# EasyEDA Pro project ProPrj_Avaota A1 八核 AIoT 开发板_2024-05-20.epro, board PCB1 (continued)
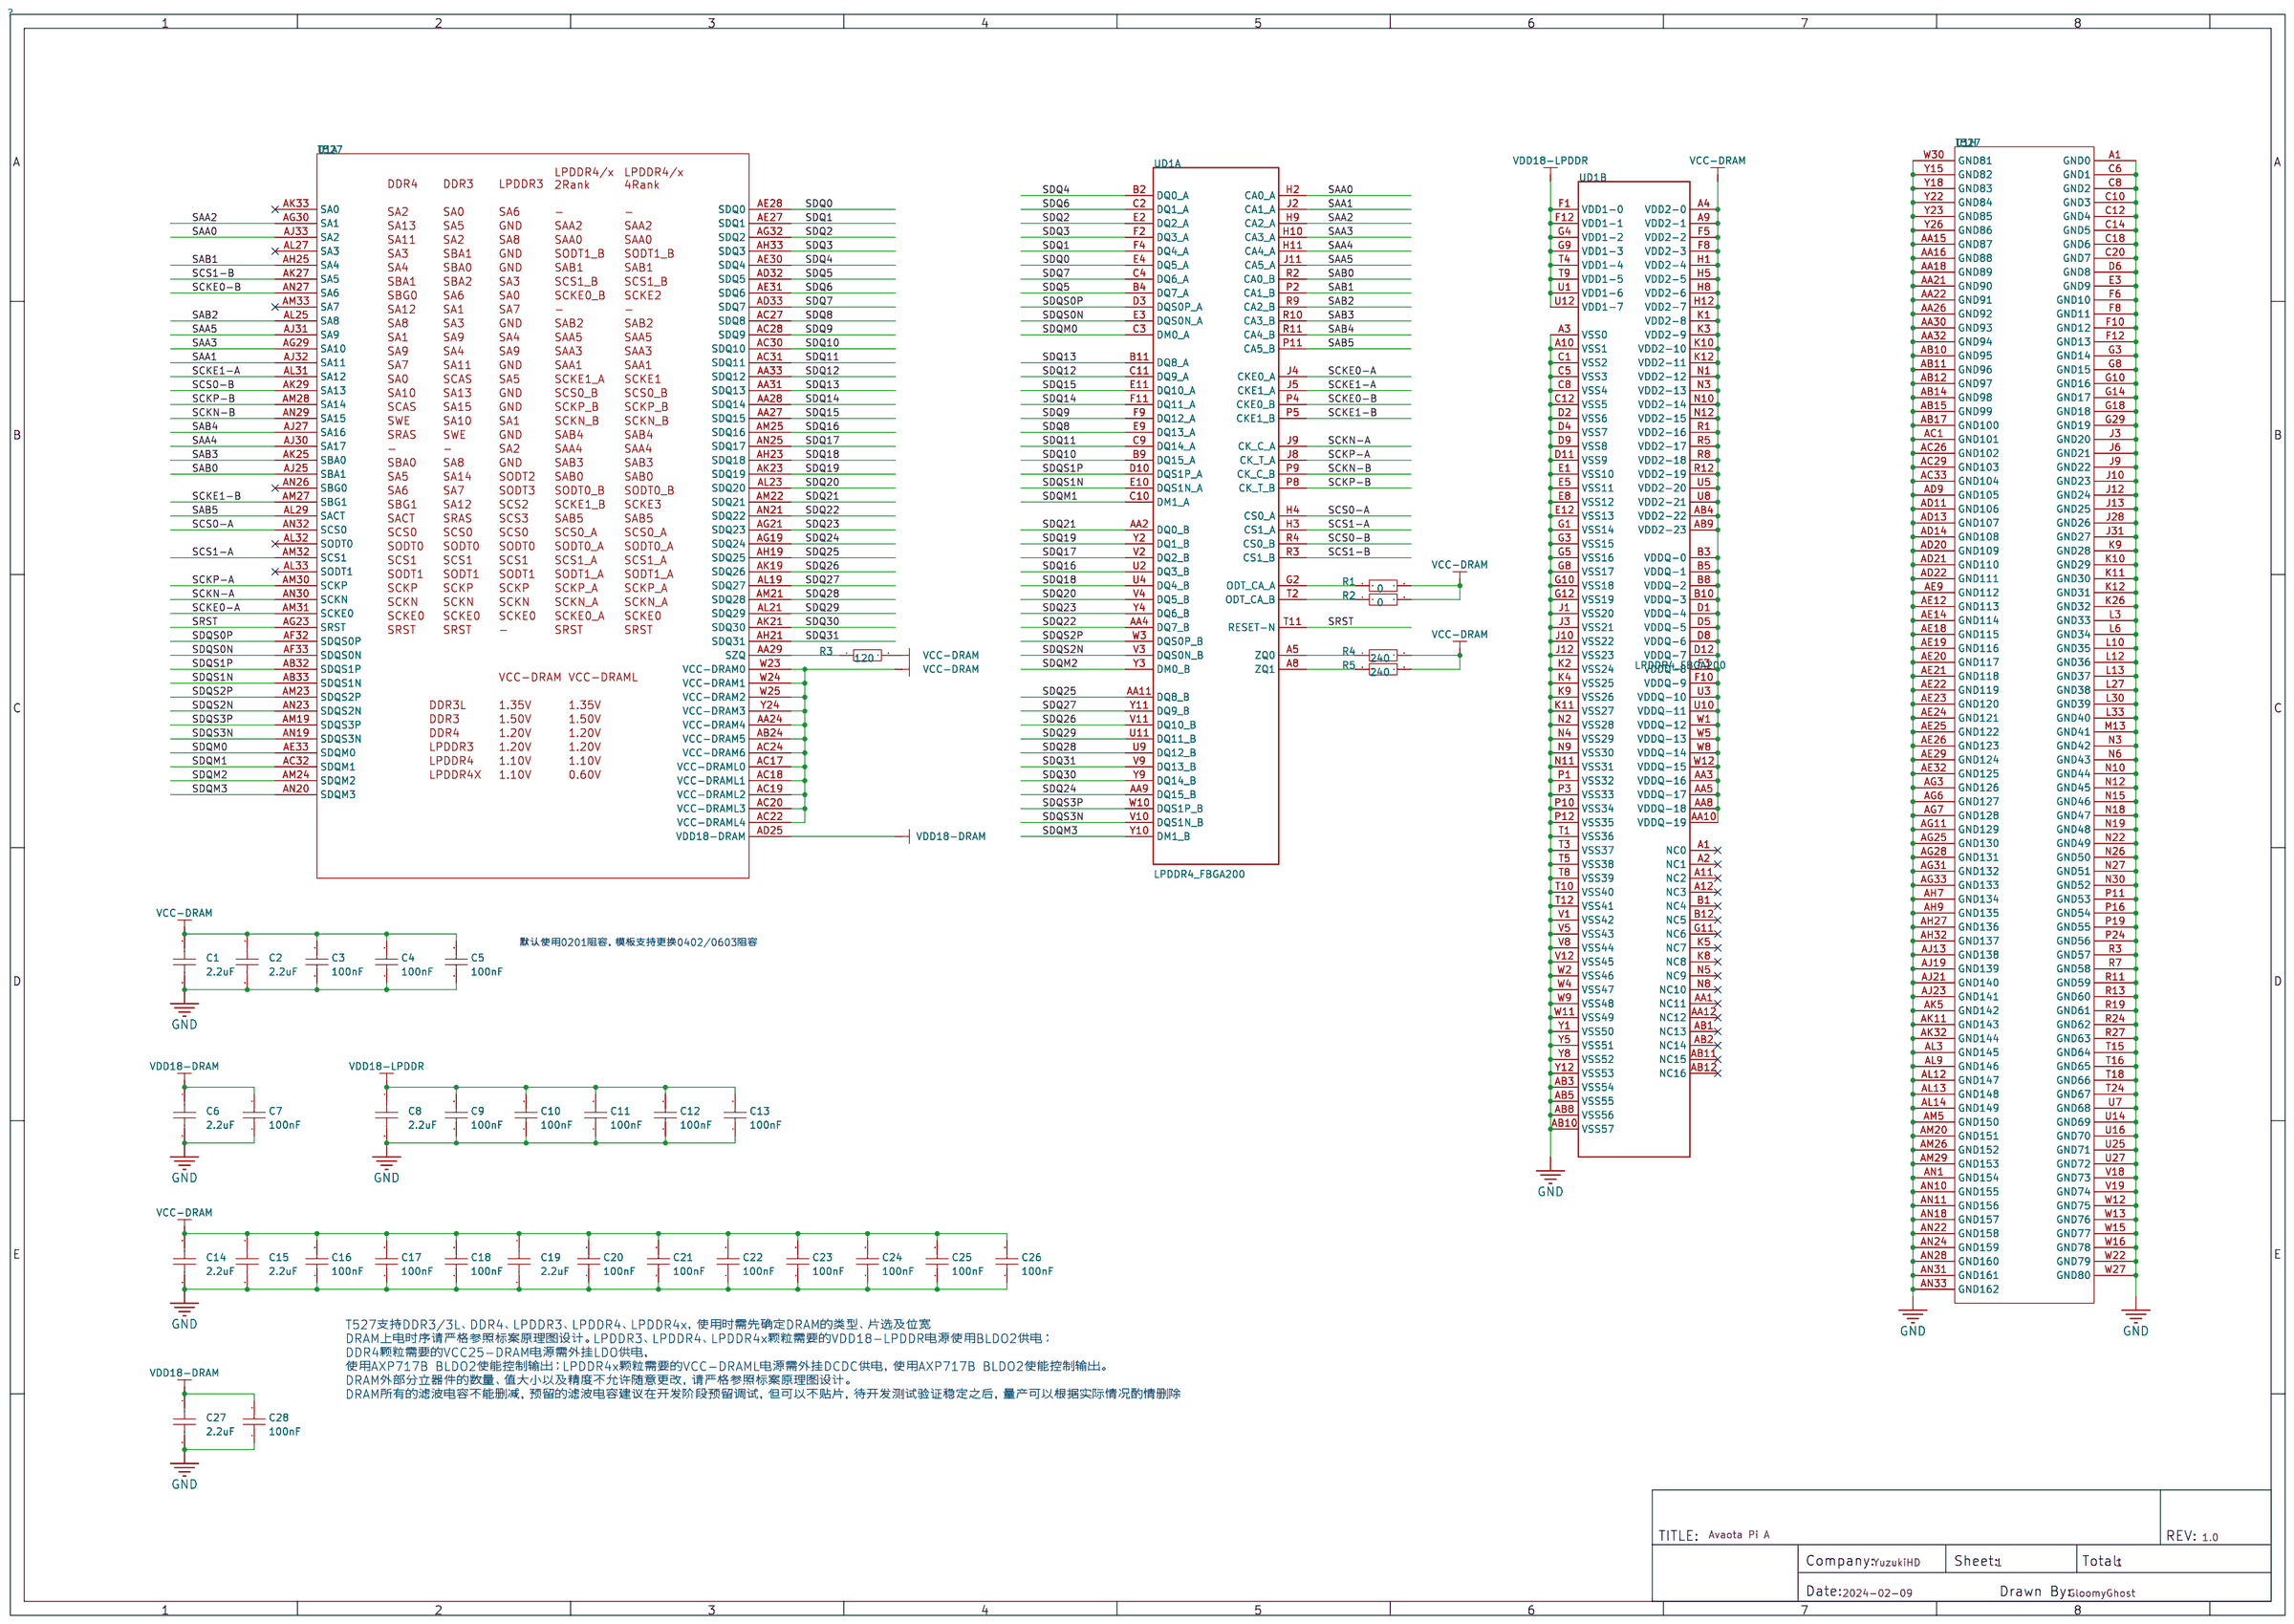
[diagram p0: schematic sheet]
## Routing (per net, layer and track width the routed paths; a pad name or vN(x,y) marks a point on that pad's centre or on a via; arc(x,y) is an arc through that point) (continued)
  Bottom Layer w0.254: 51.81,43.63 51.81,43.51 v2(52.09,43.23) ; 51.81,43.63 51.66,43.79 51.61,43.79 ; 51.81,43.63 51.81,43.84 52.55,43.84 52.58,43.87 ; 43.2,43.2 42.73,43.2 v2(42.58,43.05) ; 58.32,52.65 v1(57.45,52.65) 57.54,52.57 C102.1 ; 58.32,52.65 57.94,53.04 57.94,53.48 C103.1 ; 58.32,52.65 C113.1 ; C67.2 C57.2 C58.2 ; C21.2 C22.2 61.95,44.56 60.99,44.56 ; 36.1,42.06 35.58,42.06 35.33,41.81 34.64,41.81 v2(34.52,41.94) ; v1(72.31,44.22) 73.18,43.36 73.18,40.64 74.7,39.12 76.33,39.12 78.89,36.55 78.89,31.8 76.1,29.01 48.74,29.01 45.09,25.35 36.63,25.35 v1(30.18,18.9) ; 34.75,54.27 35.11,54.27 v2(35.25,54.41) ; 60.99,44.56 v1(60.99,44.15) ; 60.99,44.56 60.99,45.03 C20.2 ; C106.1 60.03,55.99 59.72,55.68 59.72,55.02 R28.1 ; v3(63.95,41.65) 65.22,41.65 65.46,41.88 65.46,42.98 R55.1 ; v2(38.66,49.88) 38.66,49.78 38.22,49.34 ; v1(73.53,53.47) 79.63,53.47 v1(80.52,52.58) 83.62,49.48 83.62,40.54 84.48,39.68 93.52,39.68 93.74,39.46 FPC2.23 ; 28.7,18.9 28.7,19.2 35.79,26.29 44.55,26.29 48.18,29.92 75.49,29.92 76.89,31.32 76.89,32.92 v1(75.9,33.91) ; v3(72.11,35.03) 71.22,35.03 66.88,30.68 47.5,30.68 44.27,27.46 35.28,27.46 27.36,19.53 ; 33.29,40.66 33.29,40.97 v2(32.99,41.27) ; v2(40.44,39.85) 40.54,39.75 40.54,39.3 40.51,39.27 ; v1(38.73,33.22) 38.82,33.13 C230.1 ; v2(35.35,45.85) 35.61,45.85 36.02,46.26 36.07,46.26 ; C40.2 60.86,48.31 C39.2 ; v2(40.21,45.85) 39.88,45.52 39.88,45.46 ; v1(61.44,48.65) 61.2,48.89 C86.2 C83.2 C84.2 58.62,48.89 58.3,49.21 57.89,49.21 57.88,49.2 C93.1 C90.1 56.81,50.23 C14.2 56.76,50.27 C13.2 ; v2(35.33,43.92) 35.42,44.01 35.42,44.4 ; C227.1 C163.1 C164.1 62.55,43.66 C91.1 62.68,43.76 63.04,43.76 63.22,43.57 63.32,43.57 ; v3(61.06,18.24) 61.59,17.7 v3(65.58,17.7) v3(67.61,17.7) ; C176.1 65.44,45.54 64.94,45.54 ; v2(40.84,54.56) 40.56,54.28 39.52,54.28 ; C175.1 64.94,45.54 ; 64.94,45.54 C185.1 C186.1 ; 64.94,45.54 64.99,45.49 C201.1 ; C215.1 C104.1 ; C215.1 C68.2 ; C215.1 C216.1 65.18,51.13 C188.1 ; C133.1 57.91,43.06 57.91,42.74 ; C172.1 56.48,55.03 56.59,55.14 v1(56.92,55.14) ; C41.2 59.44,46.51 v1(59.44,45.14) ; 43.33,44.22 43.23,44.22 v2(42.85,43.84) 42.4,43.84 42.38,43.87 ; 57.91,42.74 v2(57.91,42.42) ; 57.91,42.74 57.97,42.8 58.34,42.8 58.42,42.87 58.42,43.65 58.95,43.65 ; 59.94,43.65 60.28,43.65 60.5,43.43 60.5,43.21 v2(60.45,43.15) ; C79.1 C29.2 4.77,51.94 C42.2 ; v2(36.23,50.43) 36.09,50.57 36.09,50.99 ; 40.03,50.32 40.03,50.78 v2(40.21,50.95) ; v1(80.85,49.1) 80.85,49.02 80.62,48.79 80.62,46.08 v1(81.1,45.59) 81.1,39.24 82.78,37.57 82.78,34.06 84.88,31.96 FPC2.8 ; C181.1 C182.1 54.31,54.78 v1(54.44,54.65) 55.17,54.65 C202.1 ; 37.99,44.22 38.35,44.22 v2(38.45,44.32) ; C173.1 63.41,49.11 v1(62.94,48.65) 63.41,48.65 C174.1 ; C94.1 v1(54.43,51.66) ; 3.99,54.82 4,54.81 C26.2 ; v2(37.82,43.74) 37.82,43.65 38.21,43.26 ; v1(72.54,52.48) 79.22,52.48 v1(80.62,51.08) 82.58,49.12 v1(82.58,45.59) 82.55,45.57 82.55,39.6 83.9,38.25 83.9,35.05 85.49,33.46 FPC2.11 ; v1(74.52,55.12) 74.52,54.94 75.26,54.2 79.93,54.2 84.51,49.63 84.51,41.5 85.55,40.46 FPC2.25 ; 42.57,51.84 42.57,51.47 v2(42.72,51.32) ; C117.2 v2(34.59,44.48) ; v3(97.71,60.22) 98.5,61.01 SIM1.6 ; 40.37,41.91 40.37,41.52 v2(40.18,41.33)
  Bottom Layer w0.508: 96.29,23.69 96.44,23.84 96.44,25.28
  Bottom Layer w0.762: RJ1.SHIELD0 RJ1.SHIELD1 ; RJ1.SHIELD0 72.79,11.9 RJ1.P10 ; RJ1.SHIELD0 75.2,9.49 RJ2.SHIELD1 RJ2.SHIELD0 91.06,11.88 RJ2.P10
  vias: v1(6.6,65.96) v1(6.6,65.18) v1(6.66,64.47) v1(6.66,63.88) v1(6.76,66.5) v1(6.68,63.04) v1(6.68,62.26) v1(7.04,61.75) v1(7.24,66.68) v1(7.49,52.96) v1(7.49,52.25) v1(7.49,51.46) v1(7.49,50.7) v1(7.9,61.62) v1(8.13,66.75) v1(8.31,52.96) v1(8.31,52.25) v1(8.31,51.46) v1(8.31,50.7) v1(8.81,61.62) v1(8.94,66.8) v1(9.12,52.96) v1(9.12,52.25) v1(9.12,51.46) v1(9.47,38.53) v1(9.78,61.7) v1(9.93,66.5) v1(9.93,52.96) v1(9.93,52.25) v1(9.93,51.46) v1(10.16,65.58) v1(10.46,62.15) v1(10.67,66.27) v1(10.59,63.32) v1(10.77,65.51) v1(10.97,62.66) v1(11.13,63.6) v1(11.46,65.48) v1(11.51,63.02) v1(11.61,66.17) v1(11.61,64.77) v1(11.91,63.63) v1(12.12,65.51) v1(12.14,64.74) v1(12.17,63.02) v1(12.5,63.65) v1(12.85,65.43) v1(12.93,62.99) v1(13.16,64.77) v1(13.33,63.7) v1(13.51,65.46) v1(13.59,63.02) v1(13.94,64.74) v1(14,63.73) v1(14.27,65.46) v1(14.43,63.02) v1(14.55,64.77) v1(14.6,63.7) v1(20.96,59.26) v1(22.22,59.26) v1(28.7,18.81) v1(57.78,26.26) v1(62.2,20.54) v1(65.38,23.56) v1(65.38,22.85) v1(65.38,22.06) v1(65.38,21.3) v1(66.19,23.56) v1(66.19,22.85) v1(66.19,22.06) v1(66.19,21.3) v1(67.01,23.56) v1(67.01,22.85) v1(67.01,22.06) v1(67.01,21.3) v1(67.82,23.56) v1(67.82,22.85) v1(67.82,22.06) v1(67.82,21.3) v1(69.37,37.9) v1(69.8,37.11) v1(71.25,34.65) v1(72.87,34.21) v1(73.46,35.66) v1(73.63,33.12) v1(73.63,31.72) v1(75.08,36.35) v1(79.3,49.78) v1(80.75,20.38) v1(83.54,23.29) v1(83.54,22.58) v1(83.54,21.79) v1(83.54,21.03) v1(84.35,23.29) v1(84.35,22.58) v1(84.35,21.79) v1(84.35,21.03) v1(85.16,23.29) v1(85.16,22.58) v1(85.16,21.79) v1(85.16,21.03) v1(85.98,23.29) v1(85.98,22.58) v1(85.98,21.79) v1(85.98,21.03) v1(90.68,36.47) v2(51.74,47.73) v3(15.85,43.49) v3(16.71,43.49) v3(16.71,42.61) v3(58.23,56.63) v3(70.18,45.3) v3(75.64,4.19) v3(76.33,1.14) v3(76.89,4.19) v3(85.47,54.43) v3(85.47,53.85) v3(85.83,57) v3(85.83,56.41)
VBUS: length 326.8
  Top Layer w0.127: R52.1 41.48,23.34 41.76,23.62 ; 41.76,23.62 39.73,23.62 v3(39.57,23.47) ; 41.76,23.62 42.27,23.62 42.54,23.34 R53.1
  Top Layer w0.152: C222.2 39.5,24.18
  Top Layer w0.203: D9.2 v3(39.57,22.25)
  Top Layer w0.254: LED5.4 2.3,8.19 1.7,8.79 1.7,10.22 LED4.4 2.42,11.14 1.68,11.89 1.68,13.15 LED3.4 2.34,14.09 1.85,14.58 v1(1.85,16.28) LED2.4
  Top Layer w0.508: U17.5 94.27,66.88 C280.2 v3(96.27,66.88) v3(96.72,66.88) ; D1.2 17.22,35.06 v1(17.22,36.07) v1(17.22,36.58)
  内层4 w0.508: v1(38.16,16.75) v1(38.49,17.08) 42.01,20.6 50.14,20.6 51.33,21.79 57.38,21.79 59.41,23.83 60.83,23.83 61.95,24.94 68.05,24.94 68.91,24.08 73.13,24.08 74.88,22.33 78.66,22.33 80.87,24.54 95.86,24.54 97.61,22.78 v1(97.61,22.25)
  Inner5 w0.508: 3.81,19.1 3.81,18.24 v1(1.85,16.28) ; 6.22,69.93 6.22,71.55 H1.2 H1.4 ; v3(96.72,66.88) v3(96.27,66.88) 95.81,66.42 95.81,62.92 96.29,62.43 96.29,55.91 95.05,54.66 95.05,51.16 95.71,50.5 95.71,48.46 97.61,46.56 v1(97.61,22.25)
  Inner5 w1.27: 10.24,43.15 10.24,43.28 v4(9.93,43.59) ; v4(9.93,43.59) 9.19,43.59 5.89,40.28 ; v4(9.93,43.59) 9.58,43.23 9.58,42.37 ; v4(9.93,43.59) 10.74,43.59 v4(10.77,43.56) ; 8.43,40.28 7.39,39.24 v1(7.39,37.44) ; 8.43,40.28 10.79,42.65 10.77,42.67 v4(10.77,42.7) v4(10.77,43.56) ; 8.43,40.28 7.49,40.28 ; 2.9,65.32 2.9,65.46 2.87,65.48 ; 2.9,65.32 6.22,68.65 6.22,69.93 ; 2.9,65.32 2.9,55.45 2.15,54.71 2.15,51.95 2.49,51.61 2.49,38.3 ; 3.2,37.72 2.69,38.21 ; 3.2,37.72 3.2,20.17 4.14,19.23 4.14,16 6.5,13.64 17.48,13.64 18.59,14.76 22.1,14.76 ; 3.2,37.72 5.77,40.28 5.89,40.28 ; 7.49,40.28 5.89,40.28 ; 7.49,40.28 9.58,42.37 ; 21.89,14.91 22.71,15.72 35.79,15.72 36.47,15.04 ; 9.58,42.37 9.58,41.96 ; 9.58,42.37 v4(10.77,43.56)
  Bottom Layer w0.203: v3(39.57,22.25) v3(39.57,23.47)
  Bottom Layer w0.254: v1(7.39,37.44) C247.2 ; v1(7.39,37.44) 7.05,37.78 FPC1.1 ; v1(7.39,37.44) 7.23,37.28 FPC1.2
  Bottom Layer w0.508: USB2.1 26.01,7.71 26.01,9.96 USB2.10 ; v1(38.16,16.75) v1(36.65,15.24) 36.45,15.04 v1(36.24,14.83) ; v1(38.49,17.08) 39.57,18.16 v3(39.57,22.25) ; v1(97.61,22.25) 97.61,23.64 U11.3 97.56,25.18 97.46,25.28
  Bottom Layer w0.762: 12.19,41.63 11.84,41.63 v4(10.77,42.7) v4(10.77,43.56) 11.13,43.56 12.19,42.49 12.19,41.63 ; 12.19,41.63 12.19,41.58 12.31,41.46 ; 12.19,41.63 12.31,41.51 12.31,41.46 ; v1(17.22,36.07) v1(17.22,36.58) 17.22,37.31 16.61,37.92 15.85,37.92 12.31,41.46
  Bottom Layer w1.27: USB2.1 25.53,5.3 28.93,1.91 36.6,1.91 38.15,3.45 38.15,13.34 C294.2
  vias: v1(4.62,50.32) v1(35.89,15.52) v1(36.98,14.66) v3(4.12,50.29) v3(4.12,49.76) v3(4.12,49.23) v3(4.12,48.66) v3(5.13,50.37) v4(9.09,43.6) v4(9.88,42.79)
VBUS-USB: length 13.7
  Top Layer w0.152: U17.1 91.97,68.11 R120.2
  Top Layer w0.508: USB3.B4A9 83.2,69.43 83.52,69.75 84.61,69.75 84.89,70.03 85.98,70.03 86.33,69.67 87.71,69.67 88.1,69.28 USB3.A4B9 88.1,67.81 89.09,66.82 C282.2 C281.2 90.59,66.86 U17.1
VCC-3V3-BLK: length 2.1
  Bottom Layer w0.254: 88.72,47.76 88.72,47.76 R126.2 88.77,46.33 C277.2
VCC-LDO-RTC: length 72.5
  Top Layer w0.152: R10.1 7.85,47.32 7.49,46.96 6.4,46.96 v3(6.27,47.09) R9.1
  Top Layer w0.203: C45.2 5.36,55.91 5.77,55.5 7.52,55.5 7.86,55.15 U4.35 ; U14.AE13 57.44,50.18 v1(57.94,50.67)
  内层2 w0.152: v1(6.4,50.24) 6.27,50.11 v3(6.27,47.09)
  Inner5 w0.381: v1(5.47,55.79) 6.55,54.71 12.42,54.71 12.55,54.58 13.59,54.58 14.22,53.95 v1(14.53,53.95)
  Bottom Layer w0.152: v1(5.47,55.79) 5.82,55.45 6.88,55.45 7.04,55.3 7.04,50.88 v1(6.4,50.24)
  Bottom Layer w0.203: v1(57.94,50.67) 57.37,51.24 51.55,51.24 47.29,55.5 16.08,55.5 v1(14.53,53.95)
VDD-CPUBFB: length 70.8
  Top Layer w0.203: v3(17.37,44.68) 17.31,44.68 U5.1 ; v3(17.65,41.86) 17.66,41.87 U5.16
  内层2 w0.254: v3(17.37,44.68) 18.59,44.68 27.1,53.19 27.1,56.08 31.9,60.88 52.58,60.88 55.63,57.84 55.63,57.48 56.57,56.54 57.18,56.54 59.82,53.9 60.88,53.9 61.29,53.49 61.29,52.63 61.9,52.02 61.95,52.02 61.95,51.33 61.49,50.88 61.49,50.37 61.72,50.14 62.31,50.14 63.37,49.07 63.37,47.37 63.96,46.79 63.96,46.48 63.12,45.65 v1(62.44,45.65)
  Bottom Layer w0.254: v3(17.37,44.68) 17.81,44.68 18.26,44.22 18.26,43.49 17.65,42.88 v3(17.65,41.86)
VDD-CPULFB: length 62
  Top Layer w0.254: v3(10.69,48.29) 10.66,48.31 U4.12
  Inner5 w0.254: v3(10.69,48.29) 10.39,47.98 10.39,45.85 11.38,44.86 13.61,44.86 17.93,49.17 25.6,49.17 32.56,56.13 46.25,56.13 51.23,51.16 51.82,51.16 52.1,50.88 52.1,50.29 52.68,49.71 53.62,49.71 54.15,49.17 57.61,49.17 57.94,48.84 58.42,48.84 58.85,48.41 58.85,47.42 59.13,47.14 v1(59.44,47.14)
VDD-DNRFB: length 52.6
  Top Layer w0.203: U5.4 15.85,44.8 15.65,45.01 15.65,45.75 15.47,45.92 v1(15.34,45.92)
  VCC w0.254: v1(15.34,45.92) 15.8,46.38 22.4,46.38 31.88,55.85 45.85,55.85 52.48,49.23 58.02,49.23 v1(58.94,50.15)
VDD-SYSFB: length 65.8
  Top Layer w0.203: v3(8.05,54.15) 8.26,54.37 U4.34
  Top Layer w0.254: v1(62.94,48.16) 62.94,47.65
  内层4 w0.254: v3(8.05,54.15) 8.05,56.01 9.09,57.05 9.09,58.29 10.85,60.05 13.94,60.05 14.55,59.44 16.87,59.44 20.07,56.24 45.47,56.24 52.55,49.15 58.75,49.15 60.27,47.62 62.56,47.62 62.94,48.01 v1(62.94,48.16)
323-ALDO1: length 0.8
  Top Layer w0.203: C69.1 17.05,40.9 U5.15
323-DCDC1/2: length 10.9
  Top Layer w0.203: v1(61.44,46.66) 61.95,46.66 ; v1(61.44,46.66) U14.U21 ; v1(61.44,46.66) v1(60.93,46.66) 60.96,46.63 v1(60.96,46.15) ; 61.95,46.66 61.95,47.14 U14.T19 ; 61.95,46.66 61.95,46.15 U14.T21 ; 61.44,46.66 U14.U19 U14.U18
  Bottom Layer w0.254: v1(61.44,45.65) C23.1 ; v1(61.44,45.65) v1(61.94,45.65) ; v1(61.44,45.65) v1(61.44,46.66) ; v1(61.94,45.65) 61.95,45.64 C22.1 62.5,45.12 62.51,45.14 ; v1(61.94,45.65) 61.94,46.94 C24.1 C19.1 61.44,46.88 v1(61.44,46.66) ; v1(61.44,46.66) v1(60.93,46.66) 60.96,46.63 v1(60.96,46.15) 60.96,45.71 60.9,45.64
  vias: v3(21.97,45.01) v3(21.97,44.36) v3(21.97,43.69) v3(21.97,43.05) v3(21.97,42.48) v3(21.97,41.76) v3(22.05,41.05) v3(22.57,41.05)
323-DCDC3: length 5.1
  Top Layer w0.254: v1(59.44,49.64) v1(59.44,50.15) U14.AA12 ; v1(59.94,49.64) v1(59.94,50.15) U14.Y12
  Bottom Layer w0.254: C83.1 59.44,49.51 v1(59.44,49.64) v1(59.44,50.15) ; C83.1 59.77,49.46 v1(59.94,49.64) 60.12,49.46 C86.1 ; C83.1 C84.1 ; C85.1 59.94,49.53 v1(59.94,50.15)
  vias: v3(18.21,48.49) v3(18.21,47.89) v3(18.73,47.89) v3(18.72,47.34)
323-DLDO1: length 0.8
  Top Layer w0.203: C71.1 15.85,40.91 U5.12
323-RTCLDO: length 1.1
  Top Layer w0.203: U5.7 14.84,43.41 14.3,43.41 14.1,43.61 C73.1
ADCIN0: length 4.1
  Bottom Layer w0.152: 60.83,52.54 60.83,55.33 R26.2 60.67,55.42 C106.2
  Bottom Layer w0.178: v3(60.44,52.15) 60.83,52.54
ADCIN1: length 4.7
  Bottom Layer w0.178: v3(60.44,51.65) 60.51,51.65 61.14,52.27 61.14,55.07 61.28,55.21 R27.2 61.28,55.94 C107.2
ALDO1: length 2.5
  Top Layer w0.203: C51.1 12.75,47.83 12.32,48.26 11.38,48.26 11.07,48.57 11.07,48.9 U4.13
ALDO2: length 2
  Top Layer w0.203: U4.14 11.58,49.07 11.96,48.69 12.35,48.69 12.63,48.41 C52.1
ALDO3: length 80
  Top Layer w0.152: v3(5.18,47.12) R11.1 R12.1
  Top Layer w0.203: U4.16 12.03,50.23 12.73,49.53 v1(12.92,49.53)
  Top Layer w0.254: v1(56.44,52.15) U14.AE11
  Top Layer w0.457: v1(49.53,61.54) 49.53,61.57 v1(49.15,61.95) 49.05,62.05 v1(42.11,62.05) v1(41.5,62.05)
  VCC w0.152: v1(12.92,49.53) 12.47,49.97 12.47,52.35 11.96,52.86 11.96,53.75 11.13,54.58 7.39,54.58 6.81,54 6.81,50.09 6.43,49.71 6.43,49.3 6.58,49.15 6.58,48.06 5.99,47.47 5.53,47.47 v3(5.18,47.12)
  Inner5 w0.457: v1(12.92,49.53) 12.57,49.53 12.14,49.96 12.14,51.21 12.73,51.79 13.37,51.79 14.79,53.21 18.62,53.21 20.6,55.19 22.92,55.19 29.78,62.05 v1(41.5,62.05)
  Bottom Layer w0.254: v1(49.53,61.54) 49.5,61.52 49.5,60.17 50.6,59.08 50.6,57.66 52.15,56.11 52.15,55.47 53.62,54 53.92,54 54.15,54.23 54.79,54.23 54.91,54.1 55.19,54.1 55.45,53.85 55.45,53.49 56.44,52.5 v1(56.44,52.15)
ALDO4: length 103.6
  Top Layer w0.102: 60.35,59.37 60.91,59.37 R20.2 ; 60.35,59.37 R19.2 ; 60.35,59.37 R31.2 v3(59.79,59.82) ; v3(58.67,59.84) R30.2 ; v3(56.97,59.79) R32.2
  Top Layer w0.203: U4.17 12.14,50.63 12.6,50.17 12.84,50.17 v1(12.92,50.09) ; v3(60.44,53.15) 59.95,52.65 59.26,52.65 58.94,52.34 U14.AB9 ; U14.AD15 U14.AG15
  Top Layer w0.254: v1(56.44,48.62) 56.44,49.14 U14.AG15
  内层2 w0.254: v3(56.97,59.79) 56.97,59.56 57.25,59.28 58.22,59.28 58.67,59.74 v3(58.67,59.84)
  VCC w0.381: v1(56.44,48.62) 56.74,48.62 57.2,48.16 57.74,48.16 58.93,49.35 ; v3(57.94,44.15) 57.94,44.91 58.19,45.16 58.72,45.16 58.93,45.36 58.93,49.35 ; 58.93,49.35 59.21,49.07 60.35,49.07 60.93,49.66 v1(60.93,51.43) 60.93,52.65 v3(60.44,53.15) 59.68,53.15 58.85,53.98 58.85,57 58.39,57.46 58.39,58.47 58.67,58.75 v3(58.67,59.84) 58.67,60.05 58.98,60.35 59.46,60.35 59.79,60.02 v3(59.79,59.82)
  Inner5 w0.457: 18.85,52.53 20.8,54.48 23.3,54.48 30.11,61.29 45.82,61.29 48.77,58.34 54.53,58.34 56.87,56.01 58.7,56.01 60.44,54.26 v3(60.44,53.15) ; 12.92,50.09 12.92,50.09 13.39,50.09 13.87,50.57 13.87,51.26 15.09,52.48 18.77,52.48
  Bottom Layer w0.127: v1(60.93,51.43) 60.76,51.26 60.19,51.26 R24.2
  Bottom Layer w0.152: v3(60.44,53.15) 60.44,53.2 59.72,53.92
  Bottom Layer w0.203: 59.72,53.34 60.25,53.34 v3(60.44,53.15)
  Bottom Layer w0.254: 57.94,44.02 57.63,43.71 57.21,43.71 56.7,44.22 52.72,44.22 52.58,44.37 ; 57.94,44.02 v3(57.94,44.15) ; 57.94,44.02 57.94,43.67 C133.2 ; v1(56.44,48.62) 56.44,48.71 56.24,48.91 C93.2 C90.2 ; 51.61,44.36 51.62,44.37 52.58,44.37 ; 52.58,44.37 52.55,44.34
ALDO-OUT: length 0.4
  Bottom Layer w0.178: v3(57.44,53.15) 57.43,53.14 57.43,53.14 C103.2
AP-NMI: length 84.4
  Top Layer w0.076: 53.04,51.4 53.7,51.4
  Top Layer w0.102: v3(52.81,51.63) 53.04,51.4 ; U14.AM10 53.94,51.65 53.7,51.4
  Top Layer w0.127: U5.11 15.3,41.76 v3(13.41,41.76)
  Top Layer w0.152: R10.2 7.79,48.01 v1(7.39,48.01) ; U4.37 7.06,54.37 7.23,54.2 7.44,54.2 v1(7.57,54.08)
  VCC w0.102: v1(7.57,54.08) 7.07,53.57 7.07,49.96 v1(7.44,49.58)
  VCC w0.152: v1(7.39,48.01) 7.39,49.53 v1(7.44,49.58)
  Bottom Layer w0.102: v3(52.81,51.63) 52.79,51.61 51.99,51.61 47.65,55.96 39.62,55.96 38.05,57.53 36.37,57.53 35.69,56.85 13.59,56.85 11.91,55.17 11.91,50.62 11.71,50.42 9.6,50.42 9.09,49.91 7.77,49.91 v1(7.44,49.58) 7.09,49.23 6.53,49.23 5.77,49.99 4.98,49.99 4.52,49.53 4.52,48.77 5.26,48.03 5.26,47.85 4.8,47.4 4.8,46.91 5.28,46.43 5.28,45.8 6.66,44.42 12.27,44.42 13.28,43.41 13.28,41.88 v3(13.41,41.76)
  Bottom Layer w0.254: C94.2 53.28,51.63 v3(52.81,51.63)
AP-RESET: length 85.4
  Top Layer w0.102: U4.1 6.26,49.11 6.76,49.61 v1(6.86,49.61)
  Top Layer w0.127: U5.13 16.25,41.03 v3(16.26,41.02)
  Top Layer w0.152: R21.2 23.36,38.89 v1(22.78,38.89) ; C95.2 6.77,47.97 R9.2 6.27,48.9 U4.1
  Top Layer w0.254: U14.AJ11 55.45,51.15 v3(55.45,51.64)
  VCC w0.127: v1(6.86,49.61) 6.83,49.58 6.83,46.2 8.84,44.2 14.5,44.2 v1(14.6,44.3)
  VCC w0.152: v3(16.26,41.02) 16.26,40.46 17.83,38.89 v1(22.78,38.89)
  Bottom Layer w0.102: v1(6.86,49.61) 7.44,50.19 9.04,50.19 9.47,50.62 11.48,50.62 11.68,50.83 11.68,55.4 13.41,57.12 35.51,57.12 36.25,57.86 38.1,57.86 39.73,56.24 47.78,56.24 52.15,51.87 52.55,51.87 52.65,51.97 52.7,51.97 52.88,52.15 54.66,52.15 55.14,51.66 55.4,51.66
  Bottom Layer w0.127: v1(14.6,44.3) 14.6,42.67 v3(16.26,41.02)
AP-WAKE-BT: length 52.7
  Top Layer w0.102: v3(61.95,54.65) U14.U4
  Top Layer w0.203: R69.2 15.61,60.5 15.72,60.6
  Top Layer w0.254: v3(17.02,60.53) U9.6
  Inner5 w0.102: v3(61.95,54.65) 60.8,54.65 57.84,57.61 56.34,57.61 55.07,58.88 48.97,58.88 45.14,62.71 22.07,62.71 19.3,59.94 17.6,59.94 v3(17.02,60.53)
AXP717-CC1: length 3.9
  Top Layer w0.102: D24.2 86.66,66.43 86.66,65.35 86.98,65.04 R130.2
  Top Layer w0.127: 87.07,66.86 87.07,67.44 86.92,67.59 86.92,68.53 USB3.A5
AXP717-CC2: length 2.8
  Top Layer w0.102: D31.2 83.11,66.92 R129.2
  Top Layer w0.127: USB3.B5 83.9,67.6 D31.2 83.13,66.84
BLDO1: length 99.3
  Top Layer w0.152: U14.T9 62.08,52.15 62.46,52.53 v3(62.46,52.68) ; U14.N9 v3(63.44,52.58)
  Top Layer w0.203: U4.18 12.24,51.03 12.62,50.65 v1(12.92,50.65)
  Top Layer w0.254: C179.2 C180.2 14.12,61.71 v1(14.12,61.19) 14.12,60.53 ; 14.12,60.53 R69.1 ; 14.12,60.53 14.12,59.91 R70.1
  Top Layer w0.508: v1(24.71,57.99) 26.04,56.66 U9.22
  VCC w0.381: 53.75,53.59 54.2,53.14 56.44,53.14 v1(56.92,53.62)
  VCC w0.508: 53.75,53.7 47.29,60.15 30.4,60.15 v1(28.68,58.42) 24.94,54.69 14.49,54.69 13.99,54.18 13.99,51.25 13.39,50.65 v1(12.92,50.65)
  Inner5 w0.254: v1(56.92,53.62) 57.02,53.72 57.51,53.72 57.91,53.31 57.91,52.96 58.22,52.65 60.91,52.65 61.42,52.15 61.87,52.15 ; v3(63.44,52.58) 63.44,52.47 63.12,52.15 62.07,52.15 ; 62.07,52.15 61.87,52.15 ; 62.07,52.15 62.46,52.54 v3(62.46,52.68) ; v1(63.42,44.65) 63.55,44.53 64.08,44.53 64.44,44.88 64.44,47.04 64.9,47.5 64.9,49.81 64.57,50.14 64.21,50.14 62.99,51.36 62.66,51.36 61.87,52.15
  Bottom Layer w0.254: C171.2 C166.2 63.32,44.55 v1(63.42,44.65) ; v1(56.92,53.62) 56.77,53.62 56.44,53.95 C172.2 ; C165.2 63.45,52.58 v3(63.44,52.58)
  Bottom Layer w0.508: v1(14.12,61.19) 14.6,61.19 17.81,57.99 v1(24.71,57.99) 25.15,58.42 v1(28.68,58.42)
BLDO2: length 52
  Top Layer w0.102: 35.81,50.05 v2(35.46,49.7)
  Top Layer w0.127: U5.14 16.65,40.66 v3(16.64,40.64)
  Top Layer w0.203: v1(12.92,51.21) 12.89,51.23 12.5,51.23 12.3,51.43 U4.19
  Top Layer w0.254: v2(39.39,50.32) 39.54,50.32 39.81,50.05 ; 32.23,51.71 32.23,51.09 32.37,51.09 33.07,50.39 v2(33.1,50.39) 33.41,50.7 ; v2(39.38,43.77) 39.4,43.77 39.81,44.18 39.81,44.2 ; 42.21,43.55 42.15,43.55 v2(41.81,43.21) ; v2(36.23,43.96) 36.23,43.96 36.22,43.97 36.04,43.97 35.81,44.2 ; 33.41,43.55 v2(32.87,43.55) 32.7,43.71 32.23,43.71
  Top Layer w0.305: 42.21,50.7 41.87,50.37 41.84,50.37 v2(41.83,50.36)
  内层4 w0.508: v2(33.1,50.39) 32.48,50.39 31.57,49.48 17.83,49.48 15.75,51.56 v1(15.06,51.56) 13.27,51.56 v1(12.92,51.21)
  Bottom Layer w0.152: v3(16.64,40.64) 16.64,41.22 15.06,42.8 15.06,44.78 14.48,45.36 14.48,50.98 v1(15.06,51.56)
  Bottom Layer w0.203: 41.81,43.87 41.81,44.25 41.12,44.93 39.8,44.93 39.8,44.19 v2(39.38,43.77)
  Bottom Layer w0.254: 35.99,44.4 35.99,44.2 v2(36.23,43.96) ; v2(32.87,43.55) 32.83,43.55 ; v2(39.38,43.77) 39.3,43.77 38.78,43.26 ; v2(33.1,50.39) 33.14,50.34 33.78,50.34 34.16,49.96 34.16,49.51 34.39,49.28 35.02,49.28 35.45,49.7 v2(35.46,49.7) ; 41.81,43.87 v2(41.81,43.21)
BLDO3: length 84.1
  Top Layer w0.152: U14.AJ5 55.64,53.95 v3(55.93,53.95)
  Top Layer w0.203: v1(12.92,52.32) 12.57,52.32 12.48,52.23 U4.21
  Top Layer w0.254: U14.J15 65.46,49.16 64.96,49.66 64.45,49.66 ; v1(63.96,45.09) 63.96,45.16 U14.L22 ; U14.M21 63.94,46.22 v1(63.53,46.63) ; 64.45,49.66 v1(64.44,49.66) ; 64.45,49.66 U14.K13 ; U14.M10 63.96,51.63 v1(63.96,51.13)
  内层2 w0.254: v1(63.96,51.13) 65.1,51.13 65.63,51.66 68.94,51.66 70,52.73 v1(70.36,52.73)
  VCC w0.381: v3(55.93,53.95) 55.75,54.13 54.1,54.13 47.4,60.83 30.1,60.83 24.56,55.3 14.25,55.3 13.41,54.46 13.41,52.82 v1(12.92,52.32)
  Bottom Layer w0.127: C187.2 64.36,47.55
  Bottom Layer w0.254: C201.2 64.01,45.03 v1(63.96,45.09) ; C202.2 55.62,54.26 v3(55.93,53.95) ; R127.1 R128.1 70.28,52.81 v1(70.36,52.73)
  Bottom Layer w0.381: v3(55.93,53.95) 55.93,53.7 56.95,52.68 56.95,51.89 57.18,51.66 57.99,51.66 59,50.65 60.6,50.65 61.11,50.14 C208.2 63.96,50.14
  Bottom Layer w0.457: 64.36,47.55 65,48.18 65,49.38 64.72,49.66 v1(64.44,49.66) 63.96,50.14 v1(63.96,51.13) ; v1(63.96,45.09) 63.83,45.21 C185.2 C186.2 63.83,46.33 v1(63.53,46.63) 63.63,46.63 64.52,47.52
BLDO4: length 1.4
  Top Layer w0.203: U4.22 12.32,52.63 12.55,52.86 C65.1
BOOT-SEL-ADC: length 4.3
  Top Layer w0.076: 59.83,57.33 60.07,56.44 60.42,56.18
  Top Layer w0.102: 58.67,58.85 58.98,58.55 59.59,58.55 59.83,58.3 59.83,57.33 ; 58.67,58.85 58.64,58.89 R33.2 ; 58.67,58.85 R30.1
BT-RESETN: length 45.6
  Top Layer w0.076: 60.93,57.78 60.91,57.23 60.96,56.79 61.18,56.38 61.19,56.38 61.19,55.39 61.44,55.14
  Top Layer w0.102: 26.06,66.45 v1(26.06,65.19) ; v3(35.94,58.24) 36.14,58.45 54.86,58.45 56.64,60.22 60.99,60.22 61.49,59.72 61.49,58.67 60.93,58.11 60.93,57.76
  Bottom Layer w0.102: v1(26.06,65.19) 28.86,65.19 35.41,58.65 35.53,58.65 v3(35.94,58.24)
BT-WAKE-AP: length 54.8
  Top Layer w0.102: U14.U5 v3(61.95,54.15)
  Top Layer w0.203: R70.2 15.56,59.87 15.72,59.7
  Top Layer w0.254: 15.7,59.63 16.24,59.63 16.54,59.92 17.22,59.92 17.5,60.2 v3(17.5,60.71)
  Inner5 w0.102: v3(17.5,60.71) 17.5,60.5 17.81,60.2 19.15,60.2 22.02,63.07 45.19,63.07 49.07,59.18 55.14,59.18 56.44,57.89 57.96,57.89 60.86,54.99 62.1,54.99 62.31,54.79 62.31,54.5 v3(61.95,54.15)
CAN-RX0: length 116.6
  Top Layer w0.152: U14.AJ17 55.42,48.16 v3(55.42,48.59)
  内层2 w0.102: v1(45.39,57.76) 45.77,57.38 46,57.38 46.96,56.41 49.86,56.41 51.84,54.43 51.84,51.37 54.14,49.07 55.18,49.07 55.42,48.83 v3(55.42,48.59)
  内层4 w0.102: v1(44.17,64.85) 45.42,66.09 52.43,66.09 57.56,60.96 60.91,60.96 62.28,59.59 86.11,59.59 88.72,56.97 88.72,53.72 87.25,52.25 87.25,33.07 94.49,25.83 95.73,25.83 98.58,22.99 v1(98.58,21.51)
  Bottom Layer w0.102: v1(44.17,64.85) 44.17,64.14 44.4,63.91 44.4,60.12 45.57,58.95 45.57,57.94 v1(45.39,57.76) ; U11.4 98.83,21.77 v1(98.58,21.51)
CAN-TX0: length 108.9
  Top Layer w0.152: U14.AH17 55.93,48.16 v3(55.93,48.59)
  内层2 w0.102: v1(45.97,57.79) 45.98,57.79 47.1,56.67 50.04,56.67 52.1,54.61 52.1,51.46 54.25,49.31 55.34,49.31 55.93,48.72 v3(55.93,48.59)
  内层4 w0.102: v1(94.84,25.4) 94.46,25.4 86.89,32.97 86.89,52.35 88.42,53.87 88.42,56.87 85.95,59.33 62.13,59.33 60.78,60.68 57.35,60.68 52.25,65.79 45.67,65.79 v1(44.7,64.82)
  Bottom Layer w0.102: v1(44.7,64.82) 44.7,60.27 45.97,59 v1(45.97,57.79) ; U11.1 95.02,25.22 v1(94.84,25.4)
CLDO1: length 79
  Top Layer w0.127: U8.N4 U8.M4 ; U8.N4 U8.P5 ; U8.N4 U8.P3 35.8,34.52 v3(35.59,34.52)
  Top Layer w0.203: U4.23 12.24,53.03 12.6,53.39 v3(12.88,53.39)
  Top Layer w0.254: v3(41.22,33.3) 41.58,33.3 U8.C6
  Bottom Layer w0.508: v3(41.22,33.3) 41.22,31.72 41.18,31.67 ; v3(12.88,53.39) 13.79,52.48 13.79,42.32 20.62,35.48 35.03,35.48 35.59,34.93 v3(35.59,34.52) 35.59,32.39 36.3,31.67 41.18,31.67 ; v3(61.44,43.64) 61.44,40.84 60.55,39.95 60.55,37.92 57.07,34.44 44.98,34.44 42.22,31.67 41.18,31.67
CLDO2: length 117.3
  Top Layer w0.203: v1(12.92,53.95) 12.62,53.95 12.1,53.43 U4.24
  Top Layer w0.254: v1(62.03,41.91) 62.03,43.23 U14.R26
  VCC w0.254: v1(12.92,53.95) 12.92,54.29 11.57,55.64 7.68,55.64 5.96,53.91 5.96,52.72 3.7,50.46 3.7,23.83 7.44,20.09 21.16,20.09 21.62,20.55 25.78,20.55 31.75,26.52 34.39,26.52 37.39,29.52 37.39,32.66 38.59,33.87 57.36,33.87 62.03,38.53 v1(62.03,41.91)
  Bottom Layer w0.254: v1(62.03,41.91) 62.48,42.37 62.48,43.03 C91.2
CLDO3: length 330.1
  Top Layer w0.127: v1(29.13,22.81) 30.84,22.81 34.66,18.99 R47.1
  Top Layer w0.203: 11.58,54.23 11.84,54.23 12.67,55.07 v1(12.92,55.07)
  Top Layer w0.254: 40.58,33.3 U8.J10 U8.K9 ; 40.58,33.3 40.58,33.48 U8.F5 39.6,33.32 v1(39.6,33.17) ; 40.58,33.3 U8.E6
  VCC w0.254: v3(96.11,51.65) 97.16,52.69 97.16,64.57 97.54,64.95 97.54,67.97 97.05,68.45 95.17,68.45 91.69,71.93 78.54,71.93 76.2,69.6 68.71,69.6 67.13,68.02 63.7,68.02 62.56,66.88 57.8,66.88 v1(56.73,65.81)
  VCC w0.381: v1(12.92,55.07) 13.23,55.07 14,55.83 24.23,55.83 29.87,61.47 47.52,61.47 52.12,56.87 53.34,56.87 54.18,56.03 56.93,56.03 57.4,55.56 57.4,54.15 57.94,53.62 57.94,52.65 U14.AC9
  VCC w0.508: v1(82.68,28.55) 82.7,28.58 v1(83.19,28.58) 90.55,28.58 91.54,29.57 91.54,36.83 90.2,38.18 90.2,39.27 95.68,44.76 95.68,51.22 v3(96.11,51.65) ; v1(12.92,55.07) 11.8,56.18 7.05,56.18 5.36,54.48 5.36,53.24 3.1,50.98
  VCC w0.635: v1(39.6,33.17) 39.6,27.38 39.57,27.36 58.62,27.36 v1(60.07,25.91) v1(60.53,25.91)
  VCC w0.762: 39.57,27.36 37.95,25.73 32.06,25.73 v1(29.13,22.81) 25.81,19.48 6.78,19.48 2.97,23.29 2.97,50.85 3.1,50.98
  Inner5 w0.508: v1(83.19,28.58) 74.42,28.58 70.97,25.12 61.72,25.12 60.93,25.91 v1(60.53,25.91) v1(60.07,25.91)
  Bottom Layer w0.152: v1(95.72,46.76) C228.1 C234.1 ; v1(39.6,33.17) 40,32.77 C229.2 C235.2
  Bottom Layer w0.254: 57.38,66.27 57.96,66.85 63.02,66.85 64.57,68.4 65.33,68.4 65.57,68.16 R73.2 65.57,67.4 66.78,66.19 R74.2 ; 57.38,66.27 57.28,66.17 ; 57.38,66.27 57.19,66.27 v1(56.73,65.81) R75.2 ; 57.38,66.27 57.49,66.27 ; D20.1 v3(96.11,51.65) 96.11,55.25 96.88,56.01 96.88,57.12 98.56,58.81 SIM1.4 ; v1(39.6,33.17) 39.4,32.97 C230.2 ; C102.2 v1(58.44,52.15)
